# EAGLE schematic Resistor_Resistor (EAGLE 8.3.0), part 18 of 43
## Parts (continued)
R24438  10K  RESISTOR_0201  [0201]
R24439  10K  RESISTOR_0201  [0201]
R24440  10K  RESISTOR_0201  [0201]
R24441  10K  RESISTOR_0201  [0201]
R24442  10K  RESISTOR_0201  [0201]
R24443  10K  RESISTOR_0201  [0201]
R24444  10K  RESISTOR_0201  [0201]
R24445  10K  RESISTOR_0201  [0201]
R24446  10K  RESISTOR_0201  [0201]
R24447  10K  RESISTOR_0201  [0201]
R24448  10K  RESISTOR_0201  [0201]
R24449  10K  RESISTOR_0201  [0201]
R24450  10K  RESISTOR_0201  [0201]
R24451  10K  RESISTOR_0201  [0201]
R24452  10K  RESISTOR_0201  [0201]
R24453  10K  RESISTOR_0201  [0201]
R24454  10K  RESISTOR_0201  [0201]
R24455  10K  RESISTOR_0201  [0201]
R24456  10K  RESISTOR_0201  [0201]
R24457  10K  RESISTOR_0201  [0201]
R24458  10K  RESISTOR_0201  [0201]
R24459  10K  RESISTOR_0201  [0201]
R24460  10K  RESISTOR_0201  [0201]
R24461  10K  RESISTOR_0201  [0201]
R24462  10K  RESISTOR_0201  [0201]
R24463  10K  RESISTOR_0201  [0201]
R24464  10K  RESISTOR_0201  [0201]
R24465  10K  RESISTOR_0201  [0201]
R24466  10K  RESISTOR_0201  [0201]
R24467  10K  RESISTOR_0201  [0201]
R24468  10K  RESISTOR_0201  [0201]
R24469  10K  RESISTOR_0201  [0201]
R24470  10K  RESISTOR_0201  [0201]
R24471  10K  RESISTOR_0201  [0201]
R24472  10K  RESISTOR_0201  [0201]
R24473  10K  RESISTOR_0201  [0201]
R24474  10K  RESISTOR_0201  [0201]
R24475  10K  RESISTOR_0201  [0201]
R24476  10K  RESISTOR_0201  [0201]
R24477  10K  RESISTOR_0201  [0201]
R24478  10K  RESISTOR_0201  [0201]
R24479  10K  RESISTOR_0201  [0201]
R24480  10K  RESISTOR_0201  [0201]
R24481  10K  RESISTOR_0201  [0201]
R24482  10K  RESISTOR_0201  [0201]
R24483  10K  RESISTOR_0201  [0201]
R24484  10K  RESISTOR_0201  [0201]
R24485  10K  RESISTOR_0201  [0201]
R24486  10K  RESISTOR_0201  [0201]
R24487  10K  RESISTOR_0201  [0201]
R24488  10K  RESISTOR_0201  [0201]
R24489  10K  RESISTOR_0201  [0201]
R24490  10K  RESISTOR_0201  [0201]
R24491  10K  RESISTOR_0201  [0201]
R24492  10K  RESISTOR_0201  [0201]
R24493  10K  RESISTOR_0201  [0201]
R24494  10K  RESISTOR_0201  [0201]
R24495  10K  RESISTOR_0201  [0201]
R24496  10K  RESISTOR_0201  [0201]
R24497  10K  RESISTOR_0201  [0201]
R24498  10K  RESISTOR_0201  [0201]
R24499  10K  RESISTOR_0201  [0201]
R24500  10K  RESISTOR_0201  [0201]
R24501  10K  RESISTOR_0201  [0201]
R24502  10K  RESISTOR_0201  [0201]
R24503  10K  RESISTOR_0201  [0201]
R24504  10K  RESISTOR_0201  [0201]
R24505  10K  RESISTOR_0201  [0201]
R24506  10K  RESISTOR_0201  [0201]
R24507  10K  RESISTOR_0201  [0201]
R24508  10K  RESISTOR_0201  [0201]
R24509  10K  RESISTOR_0201  [0201]
R24510  10K  RESISTOR_0201  [0201]
R24511  10K  RESISTOR_0201  [0201]
R24512  10K  RESISTOR_0201  [0201]
R24513  10K  RESISTOR_0201  [0201]
R24514  10K  RESISTOR_0201  [0201]
R24515  10K  RESISTOR_0201  [0201]
R24516  10K  RESISTOR_0201  [0201]
R24517  10K  RESISTOR_0201  [0201]
R24518  10K  RESISTOR_0201  [0201]
R24519  10K  RESISTOR_0201  [0201]
R24520  10K  RESISTOR_0201  [0201]
R24521  10K  RESISTOR_0201  [0201]
R24522  10K  RESISTOR_0201  [0201]
R24523  10K  RESISTOR_0201  [0201]
R24524  10K  RESISTOR_0201  [0201]
R24525  10K  RESISTOR_0201  [0201]
R24526  10K  RESISTOR_0201  [0201]
R24527  10K  RESISTOR_0201  [0201]
R24528  10K  RESISTOR_0201  [0201]
R24529  10K  RESISTOR_0201  [0201]
R24530  10K  RESISTOR_0201  [0201]
R24531  10K  RESISTOR_0201  [0201]
R24532  10K  RESISTOR_0201  [0201]
R24533  10K  RESISTOR_0201  [0201]
R24534  10K  RESISTOR_0201  [0201]
R24535  10K  RESISTOR_0201  [0201]
R24536  10K  RESISTOR_0201  [0201]
R24537  10K  RESISTOR_0201  [0201]
R24538  10K  RESISTOR_0201  [0201]
R24539  10K  RESISTOR_0201  [0201]
R24540  10K  RESISTOR_0201  [0201]
R24541  10K  RESISTOR_0201  [0201]
R24542  10K  RESISTOR_0201  [0201]
R24543  10K  RESISTOR_0201  [0201]
R24544  10K  RESISTOR_0201  [0201]
R24545  10K  RESISTOR_0201  [0201]
R24546  10K  RESISTOR_0201  [0201]
R24547  10K  RESISTOR_0201  [0201]
R24548  10K  RESISTOR_0201  [0201]
R24549  10K  RESISTOR_0201  [0201]
R24550  10K  RESISTOR_0201  [0201]
R24551  10K  RESISTOR_0201  [0201]
R24552  10K  RESISTOR_0201  [0201]
R24553  10K  RESISTOR_0201  [0201]
R24554  10K  RESISTOR_0201  [0201]
R24555  10K  RESISTOR_0201  [0201]
R24556  10K  RESISTOR_0201  [0201]
R24557  10K  RESISTOR_0201  [0201]
R24558  10K  RESISTOR_0201  [0201]
R24559  10K  RESISTOR_0201  [0201]
R24560  10K  RESISTOR_0201  [0201]
R24561  10K  RESISTOR_0201  [0201]
R24562  10K  RESISTOR_0201  [0201]
R24563  10K  RESISTOR_0201  [0201]
R24564  10K  RESISTOR_0201  [0201]
R24565  10K  RESISTOR_0201  [0201]
R24566  10K  RESISTOR_0201  [0201]
R24567  10K  RESISTOR_0201  [0201]
R24568  10K  RESISTOR_0201  [0201]
R24569  10K  RESISTOR_0201  [0201]
R24570  10K  RESISTOR_0201  [0201]
R24571  10K  RESISTOR_0201  [0201]
R24572  10K  RESISTOR_0201  [0201]
R24573  10K  RESISTOR_0201  [0201]
R24574  10K  RESISTOR_0201  [0201]
R24575  10K  RESISTOR_0201  [0201]
R24576  10K  RESISTOR_0201  [0201]
R24577  10K  RESISTOR_0201  [0201]
R24578  10K  RESISTOR_0201  [0201]
R24579  10K  RESISTOR_0201  [0201]
R24580  10K  RESISTOR_0201  [0201]
R24581  10K  RESISTOR_0201  [0201]
R24582  10K  RESISTOR_0201  [0201]
R24583  10K  RESISTOR_0201  [0201]
R24584  10K  RESISTOR_0201  [0201]
R24585  10K  RESISTOR_0201  [0201]
R24586  10K  RESISTOR_0201  [0201]
R24587  10K  RESISTOR_0201  [0201]
R24588  10K  RESISTOR_0201  [0201]
R24589  10K  RESISTOR_0201  [0201]
R24590  10K  RESISTOR_0201  [0201]
R24591  10K  RESISTOR_0201  [0201]
R24592  10K  RESISTOR_0201  [0201]
R24593  10K  RESISTOR_0201  [0201]
R24594  10K  RESISTOR_0201  [0201]
R24595  10K  RESISTOR_0201  [0201]
R24596  10K  RESISTOR_0201  [0201]
R24597  10K  RESISTOR_0201  [0201]
R24598  10K  RESISTOR_0201  [0201]
R24599  10K  RESISTOR_0201  [0201]
R24600  10K  RESISTOR_0201  [0201]
R24601  10K  RESISTOR_0201  [0201]
R24602  10K  RESISTOR_0201  [0201]
R24603  10K  RESISTOR_0201  [0201]
R24604  10K  RESISTOR_0201  [0201]
R24605  10K  RESISTOR_0201  [0201]
R24606  10K  RESISTOR_0201  [0201]
R24607  10K  RESISTOR_0201  [0201]
R24608  10K  RESISTOR_0201  [0201]
R24609  10K  RESISTOR_0201  [0201]
R24610  10K  RESISTOR_0201  [0201]
R24611  10K  RESISTOR_0201  [0201]
R24612  10K  RESISTOR_0201  [0201]
R24613  10K  RESISTOR_0201  [0201]
R24614  10K  RESISTOR_0201  [0201]
R24615  10K  RESISTOR_0201  [0201]
R24616  10K  RESISTOR_0201  [0201]
R24617  10K  RESISTOR_0201  [0201]
R24618  10K  RESISTOR_0201  [0201]
R24619  10K  RESISTOR_0201  [0201]
R24620  10K  RESISTOR_0201  [0201]
R24621  10K  RESISTOR_0201  [0201]
R24622  10K  RESISTOR_0201  [0201]
R24623  10K  RESISTOR_0201  [0201]
R24624  10K  RESISTOR_0201  [0201]
R24625  10K  RESISTOR_0201  [0201]
R24626  10K  RESISTOR_0201  [0201]
R24627  10K  RESISTOR_0201  [0201]
R24628  10K  RESISTOR_0201  [0201]
R24629  10K  RESISTOR_0201  [0201]
R24630  10K  RESISTOR_0201  [0201]
R24631  10K  RESISTOR_0201  [0201]
R24632  10K  RESISTOR_0201  [0201]
R24633  10K  RESISTOR_0201  [0201]
R24634  10K  RESISTOR_0201  [0201]
R24635  10K  RESISTOR_0201  [0201]
R24636  10K  RESISTOR_0201  [0201]
R24637  10K  RESISTOR_0201  [0201]
R24638  10K  RESISTOR_0201  [0201]
R24639  10K  RESISTOR_0201  [0201]
R24640  10K  RESISTOR_0201  [0201]
R24641  10K  RESISTOR_0201  [0201]
R24642  10K  RESISTOR_0201  [0201]
R24643  10K  RESISTOR_0201  [0201]
R24644  10K  RESISTOR_0201  [0201]
R24645  10K  RESISTOR_0201  [0201]
R24646  10K  RESISTOR_0201  [0201]
R24647  10K  RESISTOR_0201  [0201]
R24648  10K  RESISTOR_0201  [0201]
R24649  10K  RESISTOR_0201  [0201]
R24650  10K  RESISTOR_0201  [0201]
R24651  10K  RESISTOR_0201  [0201]
R24652  10K  RESISTOR_0201  [0201]
R24653  10K  RESISTOR_0201  [0201]
R24654  10K  RESISTOR_0201  [0201]
R24655  10K  RESISTOR_0201  [0201]
R24656  10K  RESISTOR_0201  [0201]
R24657  10K  RESISTOR_0201  [0201]
R24658  10K  RESISTOR_0201  [0201]
R24659  10K  RESISTOR_0201  [0201]
R24660  10K  RESISTOR_0201  [0201]
R24661  10K  RESISTOR_0201  [0201]
R24662  10K  RESISTOR_0201  [0201]
R24663  10K  RESISTOR_0201  [0201]
R24664  10K  RESISTOR_0201  [0201]
R24665  10K  RESISTOR_0201  [0201]
R24666  10K  RESISTOR_0201  [0201]
R24667  10K  RESISTOR_0201  [0201]
R24668  10K  RESISTOR_0201  [0201]
R24669  10K  RESISTOR_0201  [0201]
R24670  10K  RESISTOR_0201  [0201]
R24671  10K  RESISTOR_0201  [0201]
R24672  10K  RESISTOR_0201  [0201]
R24673  10K  RESISTOR_0201  [0201]
R24674  10K  RESISTOR_0201  [0201]
R24675  10K  RESISTOR_0201  [0201]
R24676  10K  RESISTOR_0201  [0201]
R24677  10K  RESISTOR_0201  [0201]
R24678  10K  RESISTOR_0201  [0201]
R24679  10K  RESISTOR_0201  [0201]
R24680  10K  RESISTOR_0201  [0201]
R24681  10K  RESISTOR_0201  [0201]
R24682  10K  RESISTOR_0201  [0201]
R24683  10K  RESISTOR_0201  [0201]
R24684  10K  RESISTOR_0201  [0201]
R24685  10K  RESISTOR_0201  [0201]
R24686  10K  RESISTOR_0201  [0201]
R24687  10K  RESISTOR_0201  [0201]
R24688  10K  RESISTOR_0201  [0201]
R24689  10K  RESISTOR_0201  [0201]
R24690  10K  RESISTOR_0201  [0201]
R24691  10K  RESISTOR_0201  [0201]
R24692  10K  RESISTOR_0201  [0201]
R24693  10K  RESISTOR_0201  [0201]
R24694  10K  RESISTOR_0201  [0201]
R24695  10K  RESISTOR_0201  [0201]
R24696  10K  RESISTOR_0201  [0201]
R24697  10K  RESISTOR_0201  [0201]
R24698  10K  RESISTOR_0201  [0201]
R24699  10K  RESISTOR_0201  [0201]
R24700  10K  RESISTOR_0201  [0201]
R24701  10K  RESISTOR_0201  [0201]
R24702  10K  RESISTOR_0201  [0201]
R24703  10K  RESISTOR_0201  [0201]
R24704  10K  RESISTOR_0201  [0201]
R24705  10K  RESISTOR_0201  [0201]
R24706  10K  RESISTOR_0201  [0201]
R24707  10K  RESISTOR_0201  [0201]
R24708  10K  RESISTOR_0201  [0201]
R24709  10K  RESISTOR_0201  [0201]
R24710  10K  RESISTOR_0201  [0201]
R24711  10K  RESISTOR_0201  [0201]
R24712  10K  RESISTOR_0201  [0201]
R24713  10K  RESISTOR_0201  [0201]
R24714  10K  RESISTOR_0201  [0201]
R24715  10K  RESISTOR_0201  [0201]
R24716  10K  RESISTOR_0201  [0201]
R24717  10K  RESISTOR_0201  [0201]
R24718  10K  RESISTOR_0201  [0201]
R24719  10K  RESISTOR_0201  [0201]
R24720  10K  RESISTOR_0201  [0201]
R24721  10K  RESISTOR_0201  [0201]
R24722  10K  RESISTOR_0201  [0201]
R24723  10K  RESISTOR_0201  [0201]
R24724  10K  RESISTOR_0201  [0201]
R24725  10K  RESISTOR_0201  [0201]
R24726  10K  RESISTOR_0201  [0201]
R24727  10K  RESISTOR_0201  [0201]
R24728  10K  RESISTOR_0201  [0201]
R24729  10K  RESISTOR_0201  [0201]
R24730  10K  RESISTOR_0201  [0201]
R24731  10K  RESISTOR_0201  [0201]
R24732  10K  RESISTOR_0201  [0201]
R24733  10K  RESISTOR_0201  [0201]
R24734  10K  RESISTOR_0201  [0201]
R24735  10K  RESISTOR_0201  [0201]
R24736  10K  RESISTOR_0201  [0201]
R24737  10K  RESISTOR_0201  [0201]
R24738  10K  RESISTOR_0201  [0201]
R24739  10K  RESISTOR_0201  [0201]
R24740  10K  RESISTOR_0201  [0201]
R24741  10K  RESISTOR_0201  [0201]
R24742  10K  RESISTOR_0201  [0201]
R24743  10K  RESISTOR_0201  [0201]
R24744  10K  RESISTOR_0201  [0201]
R24745  10K  RESISTOR_0201  [0201]
R24746  10K  RESISTOR_0201  [0201]
R24747  10K  RESISTOR_0201  [0201]
R24748  10K  RESISTOR_0201  [0201]
R24749  10K  RESISTOR_0201  [0201]
R24750  10K  RESISTOR_0201  [0201]
R24751  10K  RESISTOR_0201  [0201]
R24752  10K  RESISTOR_0201  [0201]
R24753  10K  RESISTOR_0201  [0201]
R24754  10K  RESISTOR_0201  [0201]
R24755  10K  RESISTOR_0201  [0201]
R24756  10K  RESISTOR_0201  [0201]
R24757  10K  RESISTOR_0201  [0201]
R24758  10K  RESISTOR_0201  [0201]
R24759  10K  RESISTOR_0201  [0201]
R24760  10K  RESISTOR_0201  [0201]
R24761  10K  RESISTOR_0201  [0201]
R24762  10K  RESISTOR_0201  [0201]
R24763  10K  RESISTOR_0201  [0201]
R24764  10K  RESISTOR_0201  [0201]
R24765  10K  RESISTOR_0201  [0201]
R24766  10K  RESISTOR_0201  [0201]
R24767  10K  RESISTOR_0201  [0201]
R24768  10K  RESISTOR_0201  [0201]
R24769  10K  RESISTOR_0201  [0201]
R24770  10K  RESISTOR_0201  [0201]
R24771  10K  RESISTOR_0201  [0201]
R24772  10K  RESISTOR_0201  [0201]
R24773  10K  RESISTOR_0201  [0201]
R24774  10K  RESISTOR_0201  [0201]
R24775  10K  RESISTOR_0201  [0201]
R24776  10K  RESISTOR_0201  [0201]
R24777  10K  RESISTOR_0201  [0201]
R24778  10K  RESISTOR_0201  [0201]
R24779  10K  RESISTOR_0201  [0201]
R24780  10K  RESISTOR_0201  [0201]
R24781  10K  RESISTOR_0201  [0201]
R24782  10K  RESISTOR_0201  [0201]
R24783  10K  RESISTOR_0201  [0201]
R24784  10K  RESISTOR_0201  [0201]
R24785  10K  RESISTOR_0201  [0201]
R24786  10K  RESISTOR_0201  [0201]
R24787  10K  RESISTOR_0201  [0201]
R24788  10K  RESISTOR_0201  [0201]
R24789  10K  RESISTOR_0201  [0201]
R24790  10K  RESISTOR_0201  [0201]
R24791  10K  RESISTOR_0201  [0201]
R24792  10K  RESISTOR_0201  [0201]
R24793  10K  RESISTOR_0201  [0201]
R24794  10K  RESISTOR_0201  [0201]
R24795  10K  RESISTOR_0201  [0201]
R24796  10K  RESISTOR_0201  [0201]
R24797  10K  RESISTOR_0201  [0201]
R24798  10K  RESISTOR_0201  [0201]
R24799  10K  RESISTOR_0201  [0201]
R24800  10K  RESISTOR_0201  [0201]
R24801  10K  RESISTOR_0201  [0201]
R24802  10K  RESISTOR_0201  [0201]
R24803  10K  RESISTOR_0201  [0201]
R24804  10K  RESISTOR_0201  [0201]
R24805  10K  RESISTOR_0201  [0201]
R24806  10K  RESISTOR_0201  [0201]
R24807  10K  RESISTOR_0201  [0201]
R24808  10K  RESISTOR_0201  [0201]
R24809  10K  RESISTOR_0201  [0201]
R24810  10K  RESISTOR_0201  [0201]
R24811  10K  RESISTOR_0201  [0201]
R24812  10K  RESISTOR_0201  [0201]
R24813  10K  RESISTOR_0201  [0201]
R24814  10K  RESISTOR_0201  [0201]
R24815  10K  RESISTOR_0201  [0201]
R24816  10K  RESISTOR_0201  [0201]
R24817  10K  RESISTOR_0201  [0201]
R24818  10K  RESISTOR_0201  [0201]
R24819  10K  RESISTOR_0201  [0201]
R24820  10K  RESISTOR_0201  [0201]
R24821  10K  RESISTOR_0201  [0201]
R24822  10K  RESISTOR_0201  [0201]
R24823  10K  RESISTOR_0201  [0201]
R24824  10K  RESISTOR_0201  [0201]
R24825  10K  RESISTOR_0201  [0201]
R24826  10K  RESISTOR_0201  [0201]
R24827  10K  RESISTOR_0201  [0201]
R24828  10K  RESISTOR_0201  [0201]
R24829  10K  RESISTOR_0201  [0201]
R24830  10K  RESISTOR_0201  [0201]
R24831  10K  RESISTOR_0201  [0201]
R24832  10K  RESISTOR_0201  [0201]
R24833  10K  RESISTOR_0201  [0201]
R24834  10K  RESISTOR_0201  [0201]
R24835  10K  RESISTOR_0201  [0201]
R24836  10K  RESISTOR_0201  [0201]
R24837  10K  RESISTOR_0201  [0201]
R24838  10K  RESISTOR_0201  [0201]
R24839  10K  RESISTOR_0201  [0201]
R24840  10K  RESISTOR_0201  [0201]
R24841  10K  RESISTOR_0201  [0201]
R24842  10K  RESISTOR_0201  [0201]
R24843  10K  RESISTOR_0201  [0201]
R24844  10K  RESISTOR_0201  [0201]
R24845  10K  RESISTOR_0201  [0201]
R24846  10K  RESISTOR_0201  [0201]
R24847  10K  RESISTOR_0201  [0201]
R24848  10K  RESISTOR_0201  [0201]
R24849  10K  RESISTOR_0201  [0201]
R24850  10K  RESISTOR_0201  [0201]
R24851  10K  RESISTOR_0201  [0201]
R24852  10K  RESISTOR_0201  [0201]
R24853  10K  RESISTOR_0201  [0201]
R24854  10K  RESISTOR_0201  [0201]
R24855  10K  RESISTOR_0201  [0201]
R24856  10K  RESISTOR_0201  [0201]
R24857  10K  RESISTOR_0201  [0201]
R24858  10K  RESISTOR_0201  [0201]
R24859  10K  RESISTOR_0201  [0201]
R24860  10K  RESISTOR_0201  [0201]
R24861  10K  RESISTOR_0201  [0201]
R24862  10K  RESISTOR_0201  [0201]
R24863  10K  RESISTOR_0201  [0201]
R24864  10K  RESISTOR_0201  [0201]
R24865  10K  RESISTOR_0201  [0201]
R24866  10K  RESISTOR_0201  [0201]
R24867  10K  RESISTOR_0201  [0201]
R24868  10K  RESISTOR_0201  [0201]
R24869  10K  RESISTOR_0201  [0201]
R24870  10K  RESISTOR_0201  [0201]
R24871  10K  RESISTOR_0201  [0201]
R24872  10K  RESISTOR_0201  [0201]
R24873  10K  RESISTOR_0201  [0201]
R24874  10K  RESISTOR_0201  [0201]
R24875  10K  RESISTOR_0201  [0201]
R24876  10K  RESISTOR_0201  [0201]
R24877  10K  RESISTOR_0201  [0201]
R24878  10K  RESISTOR_0201  [0201]
R24879  10K  RESISTOR_0201  [0201]
R24880  10K  RESISTOR_0201  [0201]
R24881  10K  RESISTOR_0201  [0201]
R24882  10K  RESISTOR_0201  [0201]
R24883  10K  RESISTOR_0201  [0201]
R24884  10K  RESISTOR_0201  [0201]
R24885  10K  RESISTOR_0201  [0201]
R24886  10K  RESISTOR_0201  [0201]
R24887  10K  RESISTOR_0201  [0201]
R24888  10K  RESISTOR_0201  [0201]
R24889  10K  RESISTOR_0201  [0201]
R24890  10K  RESISTOR_0201  [0201]
R24891  10K  RESISTOR_0201  [0201]
R24892  10K  RESISTOR_0201  [0201]
R24893  10K  RESISTOR_0201  [0201]
R24894  10K  RESISTOR_0201  [0201]
R24895  10K  RESISTOR_0201  [0201]
R24896  10K  RESISTOR_0201  [0201]
R24897  10K  RESISTOR_0201  [0201]
R24898  10K  RESISTOR_0201  [0201]
R24899  10K  RESISTOR_0201  [0201]
R24900  10K  RESISTOR_0201  [0201]
R24901  10K  RESISTOR_0201  [0201]
R24902  10K  RESISTOR_0201  [0201]
R24903  10K  RESISTOR_0201  [0201]
R24904  10K  RESISTOR_0201  [0201]
R24905  10K  RESISTOR_0201  [0201]
R24906  10K  RESISTOR_0201  [0201]
R24907  10K  RESISTOR_0201  [0201]
R24908  10K  RESISTOR_0201  [0201]
R24909  10K  RESISTOR_0201  [0201]
R24910  10K  RESISTOR_0201  [0201]
R24911  10K  RESISTOR_0201  [0201]
R24912  10K  RESISTOR_0201  [0201]
R24913  10K  RESISTOR_0201  [0201]
R24914  10K  RESISTOR_0201  [0201]
R24915  10K  RESISTOR_0201  [0201]
R24916  10K  RESISTOR_0201  [0201]
R24917  10K  RESISTOR_0201  [0201]
R24918  10K  RESISTOR_0201  [0201]
R24919  10K  RESISTOR_0201  [0201]
R24920  10K  RESISTOR_0201  [0201]
R24921  10K  RESISTOR_0201  [0201]
R24922  10K  RESISTOR_0201  [0201]
R24923  10K  RESISTOR_0201  [0201]
R24924  10K  RESISTOR_0201  [0201]
R24925  10K  RESISTOR_0201  [0201]
R24926  10K  RESISTOR_0201  [0201]
R24927  10K  RESISTOR_0201  [0201]
R24928  10K  RESISTOR_0201  [0201]
R24929  10K  RESISTOR_0201  [0201]
R24930  10K  RESISTOR_0201  [0201]
R24931  10K  RESISTOR_0201  [0201]
R24932  10K  RESISTOR_0201  [0201]
R24933  10K  RESISTOR_0201  [0201]
R24934  10K  RESISTOR_0201  [0201]
R24935  10K  RESISTOR_0201  [0201]
R24936  10K  RESISTOR_0201  [0201]
R24937  10K  RESISTOR_0201  [0201]
R24938  10K  RESISTOR_0201  [0201]
R24939  10K  RESISTOR_0201  [0201]
R24940  10K  RESISTOR_0201  [0201]
R24941  10K  RESISTOR_0201  [0201]
R24942  10K  RESISTOR_0201  [0201]
R24943  10K  RESISTOR_0201  [0201]
R24944  10K  RESISTOR_0201  [0201]
R24945  10K  RESISTOR_0201  [0201]
R24946  10K  RESISTOR_0201  [0201]
R24947  10K  RESISTOR_0201  [0201]
R24948  10K  RESISTOR_0201  [0201]
R24949  10K  RESISTOR_0201  [0201]
R24950  10K  RESISTOR_0201  [0201]
R24951  10K  RESISTOR_0201  [0201]
R24952  10K  RESISTOR_0201  [0201]
R24953  10K  RESISTOR_0201  [0201]
R24954  10K  RESISTOR_0201  [0201]
R24955  10K  RESISTOR_0201  [0201]
R24956  10K  RESISTOR_0201  [0201]
R24957  10K  RESISTOR_0201  [0201]
R24958  10K  RESISTOR_0201  [0201]
R24959  10K  RESISTOR_0201  [0201]
R24960  10K  RESISTOR_0201  [0201]
R24961  10K  RESISTOR_0201  [0201]
R24962  10K  RESISTOR_0201  [0201]
R24963  10K  RESISTOR_0201  [0201]
R24964  10K  RESISTOR_0201  [0201]
R24965  10K  RESISTOR_0201  [0201]
R24966  10K  RESISTOR_0201  [0201]
R24967  10K  RESISTOR_0201  [0201]
R24968  10K  RESISTOR_0201  [0201]
R24969  10K  RESISTOR_0201  [0201]
R24970  10K  RESISTOR_0201  [0201]
R24971  10K  RESISTOR_0201  [0201]
R24972  10K  RESISTOR_0201  [0201]
R24973  10K  RESISTOR_0201  [0201]
R24974  10K  RESISTOR_0201  [0201]
R24975  10K  RESISTOR_0201  [0201]
R24976  10K  RESISTOR_0201  [0201]
R24977  10K  RESISTOR_0201  [0201]
R24978  10K  RESISTOR_0201  [0201]
R24979  10K  RESISTOR_0201  [0201]
R24980  10K  RESISTOR_0201  [0201]
R24981  10K  RESISTOR_0201  [0201]
R24982  10K  RESISTOR_0201  [0201]
R24983  10K  RESISTOR_0201  [0201]
R24984  10K  RESISTOR_0201  [0201]
R24985  10K  RESISTOR_0201  [0201]
R24986  10K  RESISTOR_0201  [0201]
R24987  10K  RESISTOR_0201  [0201]
R24988  10K  RESISTOR_0201  [0201]
R24989  10K  RESISTOR_0201  [0201]
R24990  10K  RESISTOR_0201  [0201]
R24991  10K  RESISTOR_0201  [0201]
R24992  10K  RESISTOR_0201  [0201]
R24993  10K  RESISTOR_0201  [0201]
R24994  10K  RESISTOR_0201  [0201]
R24995  10K  RESISTOR_0201  [0201]
R24996  10K  RESISTOR_0201  [0201]
R24997  10K  RESISTOR_0201  [0201]
R24998  10K  RESISTOR_0201  [0201]
R24999  10K  RESISTOR_0201  [0201]
R25000  10K  RESISTOR_0201  [0201]
R25001  10K  RESISTOR_0201  [0201]
R25002  10K  RESISTOR_0201  [0201]
R25003  10K  RESISTOR_0201  [0201]
R25004  10K  RESISTOR_0201  [0201]
R25005  10K  RESISTOR_0201  [0201]
R25006  10K  RESISTOR_0201  [0201]
R25007  10K  RESISTOR_0201  [0201]
R25008  10K  RESISTOR_0201  [0201]
R25009  10K  RESISTOR_0201  [0201]
R25010  10K  RESISTOR_0201  [0201]
R25011  10K  RESISTOR_0201  [0201]
R25012  10K  RESISTOR_0201  [0201]
R25013  10K  RESISTOR_0201  [0201]
R25014  10K  RESISTOR_0201  [0201]
R25015  10K  RESISTOR_0201  [0201]
R25016  10K  RESISTOR_0201  [0201]
R25017  10K  RESISTOR_0201  [0201]
R25018  10K  RESISTOR_0201  [0201]
R25019  10K  RESISTOR_0201  [0201]
R25020  10K  RESISTOR_0201  [0201]
R25021  10K  RESISTOR_0201  [0201]
R25022  10K  RESISTOR_0201  [0201]
R25023  10K  RESISTOR_0201  [0201]
R25024  10K  RESISTOR_0201  [0201]
R25025  10K  RESISTOR_0201  [0201]
R25026  10K  RESISTOR_0201  [0201]
R25027  10K  RESISTOR_0201  [0201]
R25028  10K  RESISTOR_0201  [0201]
R25029  10K  RESISTOR_0201  [0201]
R25030  10K  RESISTOR_0201  [0201]
R25031  10K  RESISTOR_0201  [0201]
R25032  10K  RESISTOR_0201  [0201]
R25033  10K  RESISTOR_0201  [0201]
R25034  10K  RESISTOR_0201  [0201]
R25035  10K  RESISTOR_0201  [0201]
R25036  10K  RESISTOR_0201  [0201]
R25037  10K  RESISTOR_0201  [0201]
R25038  10K  RESISTOR_0201  [0201]
R25039  10K  RESISTOR_0201  [0201]
R25040  10K  RESISTOR_0201  [0201]
R25041  10K  RESISTOR_0201  [0201]
R25042  10K  RESISTOR_0201  [0201]
R25043  10K  RESISTOR_0201  [0201]
R25044  10K  RESISTOR_0201  [0201]
R25045  10K  RESISTOR_0201  [0201]
R25046  10K  RESISTOR_0201  [0201]
R25047  10K  RESISTOR_0201  [0201]
R25048  10K  RESISTOR_0201  [0201]
R25049  10K  RESISTOR_0201  [0201]
R25050  10K  RESISTOR_0201  [0201]
R25051  10K  RESISTOR_0201  [0201]
R25052  10K  RESISTOR_0201  [0201]
R25053  10K  RESISTOR_0201  [0201]
R25054  10K  RESISTOR_0201  [0201]
R25055  10K  RESISTOR_0201  [0201]
R25056  10K  RESISTOR_0201  [0201]
R25057  10K  RESISTOR_0201  [0201]
R25058  10K  RESISTOR_0201  [0201]
R25059  10K  RESISTOR_0201  [0201]
R25060  10K  RESISTOR_0201  [0201]
R25061  10K  RESISTOR_0201  [0201]
R25062  10K  RESISTOR_0201  [0201]
R25063  10K  RESISTOR_0201  [0201]
R25064  10K  RESISTOR_0201  [0201]
R25065  10K  RESISTOR_0201  [0201]
R25066  10K  RESISTOR_0201  [0201]
R25067  10K  RESISTOR_0201  [0201]
R25068  10K  RESISTOR_0201  [0201]
R25069  10K  RESISTOR_0201  [0201]
R25070  10K  RESISTOR_0201  [0201]
R25071  10K  RESISTOR_0201  [0201]
R25072  10K  RESISTOR_0201  [0201]
R25073  10K  RESISTOR_0201  [0201]
R25074  10K  RESISTOR_0201  [0201]
R25075  10K  RESISTOR_0201  [0201]
R25076  10K  RESISTOR_0201  [0201]
R25077  10K  RESISTOR_0201  [0201]
R25078  10K  RESISTOR_0201  [0201]
R25079  10K  RESISTOR_0201  [0201]
R25080  10K  RESISTOR_0201  [0201]
R25081  10K  RESISTOR_0201  [0201]
R25082  10K  RESISTOR_0201  [0201]
R25083  10K  RESISTOR_0201  [0201]
R25084  10K  RESISTOR_0201  [0201]
R25085  10K  RESISTOR_0201  [0201]
R25086  10K  RESISTOR_0201  [0201]
R25087  10K  RESISTOR_0201  [0201]
R25088  10K  RESISTOR_0201  [0201]
R25089  10K  RESISTOR_0201  [0201]
R25090  10K  RESISTOR_0201  [0201]
R25091  10K  RESISTOR_0201  [0201]
R25092  10K  RESISTOR_0201  [0201]
R25093  10K  RESISTOR_0201  [0201]
R25094  10K  RESISTOR_0201  [0201]
R25095  10K  RESISTOR_0201  [0201]
R25096  10K  RESISTOR_0201  [0201]
R25097  10K  RESISTOR_0201  [0201]
R25098  10K  RESISTOR_0201  [0201]
R25099  10K  RESISTOR_0201  [0201]
R25100  10K  RESISTOR_0201  [0201]
R25101  10K  RESISTOR_0201  [0201]
R25102  10K  RESISTOR_0201  [0201]
R25103  10K  RESISTOR_0201  [0201]
R25104  10K  RESISTOR_0201  [0201]
R25105  10K  RESISTOR_0201  [0201]
R25106  10K  RESISTOR_0201  [0201]
R25107  10K  RESISTOR_0201  [0201]
R25108  10K  RESISTOR_0201  [0201]
R25109  10K  RESISTOR_0201  [0201]
R25110  10K  RESISTOR_0201  [0201]
R25111  10K  RESISTOR_0201  [0201]
R25112  10K  RESISTOR_0201  [0201]
R25113  10K  RESISTOR_0201  [0201]
R25114  10K  RESISTOR_0201  [0201]
R25115  10K  RESISTOR_0201  [0201]
R25116  10K  RESISTOR_0201  [0201]
R25117  10K  RESISTOR_0201  [0201]
R25118  10K  RESISTOR_0201  [0201]
R25119  10K  RESISTOR_0201  [0201]
R25120  10K  RESISTOR_0201  [0201]
R25121  10K  RESISTOR_0201  [0201]
R25122  10K  RESISTOR_0201  [0201]
R25123  10K  RESISTOR_0201  [0201]
R25124  10K  RESISTOR_0201  [0201]
R25125  10K  RESISTOR_0201  [0201]
R25126  10K  RESISTOR_0201  [0201]
R25127  10K  RESISTOR_0201  [0201]
R25128  10K  RESISTOR_0201  [0201]
R25129  10K  RESISTOR_0201  [0201]
R25130  10K  RESISTOR_0201  [0201]
R25131  10K  RESISTOR_0201  [0201]
R25132  10K  RESISTOR_0201  [0201]
R25133  10K  RESISTOR_0201  [0201]
R25134  10K  RESISTOR_0201  [0201]
R25135  10K  RESISTOR_0201  [0201]
R25136  10K  RESISTOR_0201  [0201]
R25137  10K  RESISTOR_0201  [0201]
R25138  10K  RESISTOR_0201  [0201]
R25139  10K  RESISTOR_0201  [0201]
R25140  10K  RESISTOR_0201  [0201]
R25141  10K  RESISTOR_0201  [0201]
R25142  10K  RESISTOR_0201  [0201]
R25143  10K  RESISTOR_0201  [0201]
R25144  10K  RESISTOR_0201  [0201]
R25145  10K  RESISTOR_0201  [0201]
R25146  10K  RESISTOR_0201  [0201]
R25147  10K  RESISTOR_0201  [0201]
R25148  10K  RESISTOR_0201  [0201]
R25149  10K  RESISTOR_0201  [0201]
R25150  10K  RESISTOR_0201  [0201]
R25151  10K  RESISTOR_0201  [0201]
R25152  10K  RESISTOR_0201  [0201]
R25153  10K  RESISTOR_0201  [0201]
R25154  10K  RESISTOR_0201  [0201]
R25155  10K  RESISTOR_0201  [0201]
R25156  10K  RESISTOR_0201  [0201]
R25157  10K  RESISTOR_0201  [0201]
R25158  10K  RESISTOR_0201  [0201]
R25159  10K  RESISTOR_0201  [0201]
R25160  10K  RESISTOR_0201  [0201]
R25161  10K  RESISTOR_0201  [0201]
R25162  10K  RESISTOR_0201  [0201]
R25163  10K  RESISTOR_0201  [0201]
R25164  10K  RESISTOR_0201  [0201]
R25165  10K  RESISTOR_0201  [0201]
R25166  10K  RESISTOR_0201  [0201]
R25167  10K  RESISTOR_0201  [0201]
R25168  10K  RESISTOR_0201  [0201]
R25169  10K  RESISTOR_0201  [0201]
R25170  10K  RESISTOR_0201  [0201]
R25171  10K  RESISTOR_0201  [0201]
R25172  10K  RESISTOR_0201  [0201]
R25173  10K  RESISTOR_0201  [0201]
R25174  10K  RESISTOR_0201  [0201]
R25175  10K  RESISTOR_0201  [0201]
R25176  10K  RESISTOR_0201  [0201]
R25177  10K  RESISTOR_0201  [0201]
R25178  10K  RESISTOR_0201  [0201]
R25179  10K  RESISTOR_0201  [0201]
R25180  10K  RESISTOR_0201  [0201]
R25181  10K  RESISTOR_0201  [0201]
R25182  10K  RESISTOR_0201  [0201]
R25183  10K  RESISTOR_0201  [0201]
R25184  10K  RESISTOR_0201  [0201]
R25185  10K  RESISTOR_0201  [0201]
R25186  10K  RESISTOR_0201  [0201]
R25187  10K  RESISTOR_0201  [0201]
R25188  10K  RESISTOR_0201  [0201]
R25189  10K  RESISTOR_0201  [0201]
R25190  10K  RESISTOR_0201  [0201]
R25191  10K  RESISTOR_0201  [0201]
R25192  10K  RESISTOR_0201  [0201]
R25193  10K  RESISTOR_0201  [0201]
R25194  10K  RESISTOR_0201  [0201]
R25195  10K  RESISTOR_0201  [0201]
R25196  10K  RESISTOR_0201  [0201]
R25197  10K  RESISTOR_0201  [0201]
R25198  10K  RESISTOR_0201  [0201]
R25199  10K  RESISTOR_0201  [0201]
R25200  10K  RESISTOR_0201  [0201]
R25201  10K  RESISTOR_0201  [0201]
R25202  10K  RESISTOR_0201  [0201]
R25203  10K  RESISTOR_0201  [0201]
R25204  10K  RESISTOR_0201  [0201]
R25205  10K  RESISTOR_0201  [0201]
R25206  10K  RESISTOR_0201  [0201]
R25207  10K  RESISTOR_0201  [0201]
R25208  10K  RESISTOR_0201  [0201]
R25209  10K  RESISTOR_0201  [0201]
R25210  10K  RESISTOR_0201  [0201]
R25211  10K  RESISTOR_0201  [0201]
R25212  10K  RESISTOR_0201  [0201]
R25213  10K  RESISTOR_0201  [0201]
R25214  10K  RESISTOR_0201  [0201]
R25215  10K  RESISTOR_0201  [0201]
R25216  10K  RESISTOR_0201  [0201]
R25217  10K  RESISTOR_0201  [0201]
R25218  10K  RESISTOR_0201  [0201]
R25219  10K  RESISTOR_0201  [0201]
R25220  10K  RESISTOR_0201  [0201]
R25221  10K  RESISTOR_0201  [0201]
R25222  10K  RESISTOR_0201  [0201]
R25223  10K  RESISTOR_0201  [0201]
R25224  10K  RESISTOR_0201  [0201]
R25225  10K  RESISTOR_0201  [0201]
R25226  10K  RESISTOR_0201  [0201]
R25227  10K  RESISTOR_0201  [0201]
R25228  10K  RESISTOR_0201  [0201]
R25229  10K  RESISTOR_0201  [0201]
R25230  10K  RESISTOR_0201  [0201]
R25231  10K  RESISTOR_0201  [0201]
R25232  10K  RESISTOR_0201  [0201]
R25233  10K  RESISTOR_0201  [0201]
R25234  10K  RESISTOR_0201  [0201]
R25235  10K  RESISTOR_0201  [0201]
R25236  10K  RESISTOR_0201  [0201]
R25237  10K  RESISTOR_0201  [0201]
R25238  10K  RESISTOR_0201  [0201]
R25239  10K  RESISTOR_0201  [0201]
R25240  10K  RESISTOR_0201  [0201]
R25241  10K  RESISTOR_0201  [0201]
R25242  10K  RESISTOR_0201  [0201]
R25243  10K  RESISTOR_0201  [0201]
R25244  10K  RESISTOR_0201  [0201]
R25245  10K  RESISTOR_0201  [0201]
R25246  10K  RESISTOR_0201  [0201]
R25247  10K  RESISTOR_0201  [0201]
R25248  10K  RESISTOR_0201  [0201]
R25249  10K  RESISTOR_0201  [0201]
R25250  10K  RESISTOR_0201  [0201]
R25251  10K  RESISTOR_0201  [0201]
R25252  10K  RESISTOR_0201  [0201]
R25253  10K  RESISTOR_0201  [0201]
R25254  10K  RESISTOR_0201  [0201]
R25255  10K  RESISTOR_0201  [0201]
R25256  10K  RESISTOR_0201  [0201]
R25257  10K  RESISTOR_0201  [0201]
R25258  10K  RESISTOR_0201  [0201]
R25259  10K  RESISTOR_0201  [0201]
R25260  10K  RESISTOR_0201  [0201]
R25261  10K  RESISTOR_0201  [0201]
R25262  10K  RESISTOR_0201  [0201]
R25263  10K  RESISTOR_0201  [0201]
R25264  10K  RESISTOR_0201  [0201]
R25265  10K  RESISTOR_0201  [0201]
R25266  10K  RESISTOR_0201  [0201]
R25267  10K  RESISTOR_0201  [0201]
R25268  10K  RESISTOR_0201  [0201]
R25269  10K  RESISTOR_0201  [0201]
R25270  10K  RESISTOR_0201  [0201]
R25271  10K  RESISTOR_0201  [0201]
R25272  10K  RESISTOR_0201  [0201]
R25273  10K  RESISTOR_0201  [0201]
R25274  10K  RESISTOR_0201  [0201]
R25275  10K  RESISTOR_0201  [0201]
R25276  10K  RESISTOR_0201  [0201]
R25277  10K  RESISTOR_0201  [0201]
R25278  10K  RESISTOR_0201  [0201]
R25279  10K  RESISTOR_0201  [0201]
R25280  10K  RESISTOR_0201  [0201]
R25281  10K  RESISTOR_0201  [0201]
R25282  10K  RESISTOR_0201  [0201]
R25283  10K  RESISTOR_0201  [0201]
R25284  10K  RESISTOR_0201  [0201]
R25285  10K  RESISTOR_0201  [0201]
R25286  10K  RESISTOR_0201  [0201]
R25287  10K  RESISTOR_0201  [0201]
R25288  10K  RESISTOR_0201  [0201]
R25289  10K  RESISTOR_0201  [0201]
R25290  10K  RESISTOR_0201  [0201]
R25291  10K  RESISTOR_0201  [0201]
R25292  10K  RESISTOR_0201  [0201]
R25293  10K  RESISTOR_0201  [0201]
R25294  10K  RESISTOR_0201  [0201]
R25295  10K  RESISTOR_0201  [0201]
R25296  10K  RESISTOR_0201  [0201]
R25297  10K  RESISTOR_0201  [0201]
R25298  10K  RESISTOR_0201  [0201]
R25299  10K  RESISTOR_0201  [0201]
R25300  10K  RESISTOR_0201  [0201]
R25301  10K  RESISTOR_0201  [0201]
R25302  10K  RESISTOR_0201  [0201]
R25303  10K  RESISTOR_0201  [0201]
R25304  10K  RESISTOR_0201  [0201]
R25305  10K  RESISTOR_0201  [0201]
R25306  10K  RESISTOR_0201  [0201]
R25307  10K  RESISTOR_0201  [0201]
R25308  10K  RESISTOR_0201  [0201]
R25309  10K  RESISTOR_0201  [0201]
R25310  10K  RESISTOR_0201  [0201]
R25311  10K  RESISTOR_0201  [0201]
R25312  10K  RESISTOR_0201  [0201]
R25313  10K  RESISTOR_0201  [0201]
R25314  10K  RESISTOR_0201  [0201]
R25315  10K  RESISTOR_0201  [0201]
R25316  10K  RESISTOR_0201  [0201]
R25317  10K  RESISTOR_0201  [0201]
R25318  10K  RESISTOR_0201  [0201]
R25319  10K  RESISTOR_0201  [0201]
R25320  10K  RESISTOR_0201  [0201]
R25321  10K  RESISTOR_0201  [0201]
R25322  10K  RESISTOR_0201  [0201]
R25323  10K  RESISTOR_0201  [0201]
R25324  10K  RESISTOR_0201  [0201]
R25325  10K  RESISTOR_0201  [0201]
R25326  10K  RESISTOR_0201  [0201]
R25327  10K  RESISTOR_0201  [0201]
R25328  10K  RESISTOR_0201  [0201]
R25329  10K  RESISTOR_0201  [0201]
R25330  10K  RESISTOR_0201  [0201]
R25331  10K  RESISTOR_0201  [0201]
R25332  10K  RESISTOR_0201  [0201]
R25333  10K  RESISTOR_0201  [0201]
R25334  10K  RESISTOR_0201  [0201]
R25335  10K  RESISTOR_0201  [0201]
R25336  10K  RESISTOR_0201  [0201]
R25337  10K  RESISTOR_0201  [0201]
R25338  10K  RESISTOR_0201  [0201]
R25339  10K  RESISTOR_0201  [0201]
R25340  10K  RESISTOR_0201  [0201]
R25341  10K  RESISTOR_0201  [0201]
R25342  10K  RESISTOR_0201  [0201]
R25343  10K  RESISTOR_0201  [0201]
R25344  10K  RESISTOR_0201  [0201]
R25345  10K  RESISTOR_0201  [0201]
R25346  10K  RESISTOR_0201  [0201]
R25347  10K  RESISTOR_0201  [0201]
R25348  10K  RESISTOR_0201  [0201]
R25349  10K  RESISTOR_0201  [0201]
R25350  10K  RESISTOR_0201  [0201]
R25351  10K  RESISTOR_0201  [0201]
R25352  10K  RESISTOR_0201  [0201]
R25353  10K  RESISTOR_0201  [0201]
R25354  10K  RESISTOR_0201  [0201]
R25355  10K  RESISTOR_0201  [0201]
R25356  10K  RESISTOR_0201  [0201]
R25357  10K  RESISTOR_0201  [0201]
R25358  10K  RESISTOR_0201  [0201]
R25359  10K  RESISTOR_0201  [0201]
R25360  10K  RESISTOR_0201  [0201]
R25361  10K  RESISTOR_0201  [0201]
R25362  10K  RESISTOR_0201  [0201]
R25363  10K  RESISTOR_0201  [0201]
R25364  10K  RESISTOR_0201  [0201]
R25365  10K  RESISTOR_0201  [0201]
R25366  10K  RESISTOR_0201  [0201]
R25367  10K  RESISTOR_0201  [0201]
R25368  10K  RESISTOR_0201  [0201]
R25369  10K  RESISTOR_0201  [0201]
R25370  10K  RESISTOR_0201  [0201]
R25371  10K  RESISTOR_0201  [0201]
R25372  10K  RESISTOR_0201  [0201]
R25373  10K  RESISTOR_0201  [0201]
R25374  10K  RESISTOR_0201  [0201]
R25375  10K  RESISTOR_0201  [0201]
R25376  10K  RESISTOR_0201  [0201]
R25377  10K  RESISTOR_0201  [0201]
R25378  10K  RESISTOR_0201  [0201]
R25379  10K  RESISTOR_0201  [0201]
R25380  10K  RESISTOR_0201  [0201]
R25381  10K  RESISTOR_0201  [0201]
R25382  10K  RESISTOR_0201  [0201]
R25383  10K  RESISTOR_0201  [0201]
R25384  10K  RESISTOR_0201  [0201]
R25385  10K  RESISTOR_0201  [0201]
R25386  10K  RESISTOR_0201  [0201]
R25387  10K  RESISTOR_0201  [0201]
R25388  10K  RESISTOR_0201  [0201]
R25389  10K  RESISTOR_0201  [0201]
R25390  10K  RESISTOR_0201  [0201]
R25391  10K  RESISTOR_0201  [0201]
R25392  10K  RESISTOR_0201  [0201]
R25393  10K  RESISTOR_0201  [0201]
R25394  10K  RESISTOR_0201  [0201]
R25395  10K  RESISTOR_0201  [0201]
R25396  10K  RESISTOR_0201  [0201]
R25397  10K  RESISTOR_0201  [0201]
R25398  10K  RESISTOR_0201  [0201]
R25399  10K  RESISTOR_0201  [0201]
R25400  10K  RESISTOR_0201  [0201]
R25401  10K  RESISTOR_0201  [0201]
R25402  10K  RESISTOR_0201  [0201]
R25403  10K  RESISTOR_0201  [0201]
R25404  10K  RESISTOR_0201  [0201]
R25405  10K  RESISTOR_0201  [0201]
R25406  10K  RESISTOR_0201  [0201]
R25407  10K  RESISTOR_0201  [0201]
R25408  10K  RESISTOR_0201  [0201]
R25409  10K  RESISTOR_0201  [0201]
R25410  10K  RESISTOR_0201  [0201]
R25411  10K  RESISTOR_0201  [0201]
R25412  10K  RESISTOR_0201  [0201]
R25413  10K  RESISTOR_0201  [0201]
R25414  10K  RESISTOR_0201  [0201]
R25415  10K  RESISTOR_0201  [0201]
R25416  10K  RESISTOR_0201  [0201]
R25417  10K  RESISTOR_0201  [0201]
R25418  10K  RESISTOR_0201  [0201]
R25419  10K  RESISTOR_0201  [0201]
R25420  10K  RESISTOR_0201  [0201]
R25421  10K  RESISTOR_0201  [0201]
R25422  10K  RESISTOR_0201  [0201]
R25423  10K  RESISTOR_0201  [0201]
R25424  10K  RESISTOR_0201  [0201]
R25425  10K  RESISTOR_0201  [0201]
R25426  10K  RESISTOR_0201  [0201]
R25427  10K  RESISTOR_0201  [0201]
R25428  10K  RESISTOR_0201  [0201]
R25429  10K  RESISTOR_0201  [0201]
R25430  10K  RESISTOR_0201  [0201]
R25431  10K  RESISTOR_0201  [0201]
R25432  10K  RESISTOR_0201  [0201]
R25433  10K  RESISTOR_0201  [0201]
R25434  10K  RESISTOR_0201  [0201]
R25435  10K  RESISTOR_0201  [0201]
R25436  10K  RESISTOR_0201  [0201]
R25437  10K  RESISTOR_0201  [0201]
R25438  10K  RESISTOR_0201  [0201]
R25439  10K  RESISTOR_0201  [0201]
R25440  10K  RESISTOR_0201  [0201]
R25441  10K  RESISTOR_0201  [0201]
R25442  10K  RESISTOR_0201  [0201]
R25443  10K  RESISTOR_0201  [0201]
R25444  10K  RESISTOR_0201  [0201]
R25445  10K  RESISTOR_0201  [0201]
R25446  10K  RESISTOR_0201  [0201]
R25447  10K  RESISTOR_0201  [0201]
R25448  10K  RESISTOR_0201  [0201]
R25449  10K  RESISTOR_0201  [0201]
R25450  10K  RESISTOR_0201  [0201]
R25451  10K  RESISTOR_0201  [0201]
R25452  10K  RESISTOR_0201  [0201]
R25453  10K  RESISTOR_0201  [0201]
R25454  10K  RESISTOR_0201  [0201]
R25455  10K  RESISTOR_0201  [0201]
R25456  10K  RESISTOR_0201  [0201]
R25457  10K  RESISTOR_0201  [0201]
R25458  10K  RESISTOR_0201  [0201]
R25459  10K  RESISTOR_0201  [0201]
R25460  10K  RESISTOR_0201  [0201]
R25461  10K  RESISTOR_0201  [0201]
R25462  10K  RESISTOR_0201  [0201]
R25463  10K  RESISTOR_0201  [0201]
R25464  10K  RESISTOR_0201  [0201]
R25465  10K  RESISTOR_0201  [0201]
R25466  10K  RESISTOR_0201  [0201]
R25467  10K  RESISTOR_0201  [0201]
R25468  10K  RESISTOR_0201  [0201]
R25469  10K  RESISTOR_0201  [0201]
R25470  10K  RESISTOR_0201  [0201]
R25471  10K  RESISTOR_0201  [0201]
R25472  10K  RESISTOR_0201  [0201]
R25473  10K  RESISTOR_0201  [0201]
R25474  10K  RESISTOR_0201  [0201]
R25475  10K  RESISTOR_0201  [0201]
R25476  10K  RESISTOR_0201  [0201]
R25477  10K  RESISTOR_0201  [0201]
R25478  10K  RESISTOR_0201  [0201]
R25479  10K  RESISTOR_0201  [0201]
R25480  10K  RESISTOR_0201  [0201]
R25481  10K  RESISTOR_0201  [0201]
R25482  10K  RESISTOR_0201  [0201]
R25483  10K  RESISTOR_0201  [0201]
R25484  10K  RESISTOR_0201  [0201]
R25485  10K  RESISTOR_0201  [0201]
R25486  10K  RESISTOR_0201  [0201]
R25487  10K  RESISTOR_0201  [0201]
R25488  10K  RESISTOR_0201  [0201]
R25489  10K  RESISTOR_0201  [0201]
R25490  10K  RESISTOR_0201  [0201]
R25491  10K  RESISTOR_0201  [0201]
R25492  10K  RESISTOR_0201  [0201]
R25493  10K  RESISTOR_0201  [0201]
R25494  10K  RESISTOR_0201  [0201]
R25495  10K  RESISTOR_0201  [0201]
R25496  10K  RESISTOR_0201  [0201]
R25497  10K  RESISTOR_0201  [0201]
R25498  10K  RESISTOR_0201  [0201]
R25499  10K  RESISTOR_0201  [0201]
R25500  10K  RESISTOR_0201  [0201]
R25501  10K  RESISTOR_0201  [0201]
R25502  10K  RESISTOR_0201  [0201]
R25503  10K  RESISTOR_0201  [0201]
R25504  10K  RESISTOR_0201  [0201]
R25505  10K  RESISTOR_0201  [0201]
R25506  10K  RESISTOR_0201  [0201]
R25507  10K  RESISTOR_0201  [0201]
R25508  10K  RESISTOR_0201  [0201]
R25509  10K  RESISTOR_0201  [0201]
R25510  10K  RESISTOR_0201  [0201]
R25511  10K  RESISTOR_0201  [0201]
R25512  10K  RESISTOR_0201  [0201]
R25513  10K  RESISTOR_0201  [0201]
R25514  10K  RESISTOR_0201  [0201]
R25515  10K  RESISTOR_0201  [0201]
R25516  10K  RESISTOR_0201  [0201]
R25517  10K  RESISTOR_0201  [0201]
R25518  10K  RESISTOR_0201  [0201]
R25519  10K  RESISTOR_0201  [0201]
R25520  10K  RESISTOR_0201  [0201]
R25521  10K  RESISTOR_0201  [0201]
R25522  10K  RESISTOR_0201  [0201]
R25523  10K  RESISTOR_0201  [0201]
R25524  10K  RESISTOR_0201  [0201]
R25525  10K  RESISTOR_0201  [0201]
R25526  10K  RESISTOR_0201  [0201]
R25527  10K  RESISTOR_0201  [0201]
R25528  10K  RESISTOR_0201  [0201]
R25529  10K  RESISTOR_0201  [0201]
R25530  10K  RESISTOR_0201  [0201]
R25531  10K  RESISTOR_0201  [0201]
R25532  10K  RESISTOR_0201  [0201]
R25533  10K  RESISTOR_0201  [0201]
R25534  10K  RESISTOR_0201  [0201]
R25535  10K  RESISTOR_0201  [0201]
R25536  10K  RESISTOR_0201  [0201]
R25537  10K  RESISTOR_0201  [0201]
R25538  10K  RESISTOR_0201  [0201]
R25539  10K  RESISTOR_0201  [0201]
R25540  10K  RESISTOR_0201  [0201]
R25541  10K  RESISTOR_0201  [0201]
R25542  10K  RESISTOR_0201  [0201]
R25543  10K  RESISTOR_0201  [0201]
R25544  10K  RESISTOR_0201  [0201]
R25545  10K  RESISTOR_0201  [0201]
R25546  10K  RESISTOR_0201  [0201]
R25547  10K  RESISTOR_0201  [0201]
R25548  10K  RESISTOR_0201  [0201]
R25549  10K  RESISTOR_0201  [0201]
R25550  10K  RESISTOR_0201  [0201]
R25551  10K  RESISTOR_0201  [0201]
R25552  10K  RESISTOR_0201  [0201]
R25553  10K  RESISTOR_0201  [0201]
R25554  10K  RESISTOR_0201  [0201]
R25555  10K  RESISTOR_0201  [0201]
R25556  10K  RESISTOR_0201  [0201]
R25557  10K  RESISTOR_0201  [0201]
R25558  10K  RESISTOR_0201  [0201]
R25559  10K  RESISTOR_0201  [0201]
R25560  10K  RESISTOR_0201  [0201]
R25561  10K  RESISTOR_0201  [0201]
R25562  10K  RESISTOR_0201  [0201]
R25563  10K  RESISTOR_0201  [0201]
R25564  10K  RESISTOR_0201  [0201]
R25565  10K  RESISTOR_0201  [0201]
R25566  10K  RESISTOR_0201  [0201]
R25567  10K  RESISTOR_0201  [0201]
R25568  10K  RESISTOR_0201  [0201]
R25569  10K  RESISTOR_0201  [0201]
R25570  10K  RESISTOR_0201  [0201]
R25571  10K  RESISTOR_0201  [0201]
R25572  10K  RESISTOR_0201  [0201]
R25573  10K  RESISTOR_0201  [0201]
R25574  10K  RESISTOR_0201  [0201]
R25575  10K  RESISTOR_0201  [0201]
R25576  10K  RESISTOR_0201  [0201]
R25577  10K  RESISTOR_0201  [0201]
R25578  10K  RESISTOR_0201  [0201]
R25579  10K  RESISTOR_0201  [0201]
R25580  10K  RESISTOR_0201  [0201]
R25581  10K  RESISTOR_0201  [0201]
R25582  10K  RESISTOR_0201  [0201]
R25583  10K  RESISTOR_0201  [0201]
R25584  10K  RESISTOR_0201  [0201]
R25585  10K  RESISTOR_0201  [0201]
R25586  10K  RESISTOR_0201  [0201]
R25587  10K  RESISTOR_0201  [0201]
R25588  10K  RESISTOR_0201  [0201]
R25589  10K  RESISTOR_0201  [0201]
R25590  10K  RESISTOR_0201  [0201]
R25591  10K  RESISTOR_0201  [0201]
R25592  10K  RESISTOR_0201  [0201]
R25593  10K  RESISTOR_0201  [0201]
R25594  10K  RESISTOR_0201  [0201]
R25595  10K  RESISTOR_0201  [0201]
R25596  10K  RESISTOR_0201  [0201]
R25597  10K  RESISTOR_0201  [0201]
R25598  10K  RESISTOR_0201  [0201]
R25599  10K  RESISTOR_0201  [0201]
R25600  10K  RESISTOR_0201  [0201]
R25601  10K  RESISTOR_0201  [0201]
R25602  10K  RESISTOR_0201  [0201]
R25603  10K  RESISTOR_0201  [0201]
R25604  10K  RESISTOR_0201  [0201]
R25605  10K  RESISTOR_0201  [0201]
R25606  10K  RESISTOR_0201  [0201]
R25607  10K  RESISTOR_0201  [0201]
R25608  10K  RESISTOR_0201  [0201]
R25609  10K  RESISTOR_0201  [0201]
R25610  10K  RESISTOR_0201  [0201]
R25611  10K  RESISTOR_0201  [0201]
R25612  10K  RESISTOR_0201  [0201]
R25613  10K  RESISTOR_0201  [0201]
R25614  10K  RESISTOR_0201  [0201]
R25615  10K  RESISTOR_0201  [0201]
R25616  10K  RESISTOR_0201  [0201]
R25617  10K  RESISTOR_0201  [0201]
R25618  10K  RESISTOR_0201  [0201]
R25619  10K  RESISTOR_0201  [0201]
R25620  10K  RESISTOR_0201  [0201]
R25621  10K  RESISTOR_0201  [0201]
R25622  10K  RESISTOR_0201  [0201]
R25623  10K  RESISTOR_0201  [0201]
R25624  10K  RESISTOR_0201  [0201]
R25625  10K  RESISTOR_0201  [0201]
R25626  10K  RESISTOR_0201  [0201]
R25627  10K  RESISTOR_0201  [0201]
R25628  10K  RESISTOR_0201  [0201]
R25629  10K  RESISTOR_0201  [0201]
R25630  10K  RESISTOR_0201  [0201]
R25631  10K  RESISTOR_0201  [0201]
R25632  10K  RESISTOR_0201  [0201]
R25633  10K  RESISTOR_0201  [0201]
R25634  10K  RESISTOR_0201  [0201]
R25635  10K  RESISTOR_0201  [0201]
R25636  10K  RESISTOR_0201  [0201]
R25637  10K  RESISTOR_0201  [0201]
R25638  10K  RESISTOR_0201  [0201]
R25639  10K  RESISTOR_0201  [0201]
R25640  10K  RESISTOR_0201  [0201]
R25641  10K  RESISTOR_0201  [0201]
R25642  10K  RESISTOR_0201  [0201]
R25643  10K  RESISTOR_0201  [0201]
R25644  10K  RESISTOR_0201  [0201]
R25645  10K  RESISTOR_0201  [0201]
R25646  10K  RESISTOR_0201  [0201]
R25647  10K  RESISTOR_0201  [0201]
R25648  10K  RESISTOR_0201  [0201]
R25649  10K  RESISTOR_0201  [0201]
R25650  10K  RESISTOR_0201  [0201]
R25651  10K  RESISTOR_0201  [0201]
R25652  10K  RESISTOR_0201  [0201]
R25653  10K  RESISTOR_0201  [0201]
R25654  10K  RESISTOR_0201  [0201]
R25655  10K  RESISTOR_0201  [0201]
R25656  10K  RESISTOR_0201  [0201]
R25657  10K  RESISTOR_0201  [0201]
R25658  10K  RESISTOR_0201  [0201]
R25659  10K  RESISTOR_0201  [0201]
R25660  10K  RESISTOR_0201  [0201]
R25661  10K  RESISTOR_0201  [0201]
R25662  10K  RESISTOR_0201  [0201]
R25663  10K  RESISTOR_0201  [0201]
R25664  10K  RESISTOR_0201  [0201]
R25665  10K  RESISTOR_0201  [0201]
R25666  10K  RESISTOR_0201  [0201]
R25667  10K  RESISTOR_0201  [0201]
R25668  10K  RESISTOR_0201  [0201]
R25669  10K  RESISTOR_0201  [0201]
R25670  10K  RESISTOR_0201  [0201]
R25671  10K  RESISTOR_0201  [0201]
R25672  10K  RESISTOR_0201  [0201]
R25673  10K  RESISTOR_0201  [0201]
R25674  10K  RESISTOR_0201  [0201]
R25675  10K  RESISTOR_0201  [0201]
R25676  10K  RESISTOR_0201  [0201]
R25677  10K  RESISTOR_0201  [0201]
R25678  10K  RESISTOR_0201  [0201]
R25679  10K  RESISTOR_0201  [0201]
R25680  10K  RESISTOR_0201  [0201]
R25681  10K  RESISTOR_0201  [0201]
R25682  10K  RESISTOR_0201  [0201]
R25683  10K  RESISTOR_0201  [0201]
R25684  10K  RESISTOR_0201  [0201]
R25685  10K  RESISTOR_0201  [0201]
R25686  10K  RESISTOR_0201  [0201]
R25687  10K  RESISTOR_0201  [0201]
R25688  10K  RESISTOR_0201  [0201]
R25689  10K  RESISTOR_0201  [0201]
R25690  10K  RESISTOR_0201  [0201]
R25691  10K  RESISTOR_0201  [0201]
R25692  10K  RESISTOR_0201  [0201]
R25693  10K  RESISTOR_0201  [0201]
R25694  10K  RESISTOR_0201  [0201]
R25695  10K  RESISTOR_0201  [0201]
R25696  10K  RESISTOR_0201  [0201]
R25697  10K  RESISTOR_0201  [0201]
R25698  10K  RESISTOR_0201  [0201]
R25699  10K  RESISTOR_0201  [0201]
R25700  10K  RESISTOR_0201  [0201]
R25701  10K  RESISTOR_0201  [0201]
R25702  10K  RESISTOR_0201  [0201]
R25703  10K  RESISTOR_0201  [0201]
R25704  10K  RESISTOR_0201  [0201]
R25705  10K  RESISTOR_0201  [0201]
R25706  10K  RESISTOR_0201  [0201]
R25707  10K  RESISTOR_0201  [0201]
R25708  10K  RESISTOR_0201  [0201]
R25709  10K  RESISTOR_0201  [0201]
R25710  10K  RESISTOR_0201  [0201]
R25711  10K  RESISTOR_0201  [0201]
R25712  10K  RESISTOR_0201  [0201]
R25713  10K  RESISTOR_0201  [0201]
R25714  10K  RESISTOR_0201  [0201]
R25715  10K  RESISTOR_0201  [0201]
R25716  10K  RESISTOR_0201  [0201]
R25717  10K  RESISTOR_0201  [0201]
R25718  10K  RESISTOR_0201  [0201]
R25719  10K  RESISTOR_0201  [0201]
R25720  10K  RESISTOR_0201  [0201]
R25721  10K  RESISTOR_0201  [0201]
R25722  10K  RESISTOR_0201  [0201]
R25723  10K  RESISTOR_0201  [0201]
R25724  10K  RESISTOR_0201  [0201]
R25725  10K  RESISTOR_0201  [0201]
R25726  10K  RESISTOR_0201  [0201]
R25727  10K  RESISTOR_0201  [0201]
R25728  10K  RESISTOR_0201  [0201]
R25729  10K  RESISTOR_0201  [0201]
R25730  10K  RESISTOR_0201  [0201]
R25731  10K  RESISTOR_0201  [0201]
R25732  10K  RESISTOR_0201  [0201]
R25733  10K  RESISTOR_0201  [0201]
R25734  10K  RESISTOR_0201  [0201]
R25735  10K  RESISTOR_0201  [0201]
R25736  10K  RESISTOR_0201  [0201]
R25737  10K  RESISTOR_0201  [0201]
R25738  10K  RESISTOR_0201  [0201]
R25739  10K  RESISTOR_0201  [0201]
R25740  10K  RESISTOR_0201  [0201]
R25741  10K  RESISTOR_0201  [0201]
R25742  10K  RESISTOR_0201  [0201]
R25743  10K  RESISTOR_0201  [0201]
R25744  10K  RESISTOR_0201  [0201]
R25745  10K  RESISTOR_0201  [0201]
R25746  10K  RESISTOR_0201  [0201]
R25747  10K  RESISTOR_0201  [0201]
R25748  10K  RESISTOR_0201  [0201]
R25749  10K  RESISTOR_0201  [0201]
R25750  10K  RESISTOR_0201  [0201]
R25751  10K  RESISTOR_0201  [0201]
R25752  10K  RESISTOR_0201  [0201]
R25753  10K  RESISTOR_0201  [0201]
R25754  10K  RESISTOR_0201  [0201]
R25755  10K  RESISTOR_0201  [0201]
R25756  10K  RESISTOR_0201  [0201]
R25757  10K  RESISTOR_0201  [0201]
R25758  10K  RESISTOR_0201  [0201]
R25759  10K  RESISTOR_0201  [0201]
R25760  10K  RESISTOR_0201  [0201]
R25761  10K  RESISTOR_0201  [0201]
R25762  10K  RESISTOR_0201  [0201]
R25763  10K  RESISTOR_0201  [0201]
R25764  10K  RESISTOR_0201  [0201]
R25765  10K  RESISTOR_0201  [0201]
R25766  10K  RESISTOR_0201  [0201]
R25767  10K  RESISTOR_0201  [0201]
R25768  10K  RESISTOR_0201  [0201]
R25769  10K  RESISTOR_0201  [0201]
R25770  10K  RESISTOR_0201  [0201]
R25771  10K  RESISTOR_0201  [0201]
R25772  10K  RESISTOR_0201  [0201]
R25773  10K  RESISTOR_0201  [0201]
R25774  10K  RESISTOR_0201  [0201]
R25775  10K  RESISTOR_0201  [0201]
R25776  10K  RESISTOR_0201  [0201]
R25777  10K  RESISTOR_0201  [0201]
R25778  10K  RESISTOR_0201  [0201]
R25779  10K  RESISTOR_0201  [0201]
R25780  10K  RESISTOR_0201  [0201]
R25781  10K  RESISTOR_0201  [0201]
R25782  10K  RESISTOR_0201  [0201]
R25783  10K  RESISTOR_0201  [0201]
R25784  10K  RESISTOR_0201  [0201]
R25785  10K  RESISTOR_0201  [0201]
R25786  10K  RESISTOR_0201  [0201]
R25787  10K  RESISTOR_0201  [0201]
R25788  10K  RESISTOR_0201  [0201]
R25789  10K  RESISTOR_0201  [0201]
R25790  10K  RESISTOR_0201  [0201]
R25791  10K  RESISTOR_0201  [0201]
R25792  10K  RESISTOR_0201  [0201]
R25793  10K  RESISTOR_0201  [0201]
R25794  10K  RESISTOR_0201  [0201]
R25795  10K  RESISTOR_0201  [0201]
R25796  10K  RESISTOR_0201  [0201]
R25797  10K  RESISTOR_0201  [0201]
R25798  10K  RESISTOR_0201  [0201]
R25799  10K  RESISTOR_0201  [0201]
R25800  10K  RESISTOR_0201  [0201]
R25801  10K  RESISTOR_0201  [0201]
R25802  10K  RESISTOR_0201  [0201]
R25803  10K  RESISTOR_0201  [0201]
R25804  10K  RESISTOR_0201  [0201]
R25805  10K  RESISTOR_0201  [0201]
R25806  10K  RESISTOR_0201  [0201]
R25807  10K  RESISTOR_0201  [0201]
R25808  10K  RESISTOR_0201  [0201]
R25809  10K  RESISTOR_0201  [0201]
R25810  10K  RESISTOR_0201  [0201]
R25811  10K  RESISTOR_0201  [0201]
R25812  10K  RESISTOR_0201  [0201]
R25813  10K  RESISTOR_0201  [0201]
R25814  10K  RESISTOR_0201  [0201]
R25815  10K  RESISTOR_0201  [0201]
R25816  10K  RESISTOR_0201  [0201]
R25817  10K  RESISTOR_0201  [0201]
R25818  10K  RESISTOR_0201  [0201]
R25819  10K  RESISTOR_0201  [0201]
R25820  10K  RESISTOR_0201  [0201]
R25821  10K  RESISTOR_0201  [0201]
R25822  10K  RESISTOR_0201  [0201]
R25823  10K  RESISTOR_0201  [0201]
R25824  10K  RESISTOR_0201  [0201]
R25825  10K  RESISTOR_0201  [0201]
R25826  10K  RESISTOR_0201  [0201]
R25827  10K  RESISTOR_0201  [0201]
R25828  10K  RESISTOR_0201  [0201]
R25829  10K  RESISTOR_0201  [0201]
R25830  10K  RESISTOR_0201  [0201]
R25831  10K  RESISTOR_0201  [0201]
R25832  10K  RESISTOR_0201  [0201]
R25833  10K  RESISTOR_0201  [0201]
R25834  10K  RESISTOR_0201  [0201]
R25835  10K  RESISTOR_0201  [0201]
R25836  10K  RESISTOR_0201  [0201]
R25837  10K  RESISTOR_0201  [0201]
R25838  10K  RESISTOR_0201  [0201]
R25839  10K  RESISTOR_0201  [0201]
R25840  10K  RESISTOR_0201  [0201]
R25841  10K  RESISTOR_0201  [0201]
R25842  10K  RESISTOR_0201  [0201]
R25843  10K  RESISTOR_0201  [0201]
R25844  10K  RESISTOR_0201  [0201]
R25845  10K  RESISTOR_0201  [0201]
R25846  10K  RESISTOR_0201  [0201]
R25847  10K  RESISTOR_0201  [0201]
R25848  10K  RESISTOR_0201  [0201]
R25849  10K  RESISTOR_0201  [0201]
R25850  10K  RESISTOR_0201  [0201]
R25851  10K  RESISTOR_0201  [0201]
R25852  10K  RESISTOR_0201  [0201]
R25853  10K  RESISTOR_0201  [0201]
R25854  10K  RESISTOR_0201  [0201]
R25855  10K  RESISTOR_0201  [0201]
R25856  10K  RESISTOR_0201  [0201]
R25857  10K  RESISTOR_0201  [0201]